# EasyEDA Pro project kuafu01_030内部老化方案_4.eprj, board PCB4 (continued)
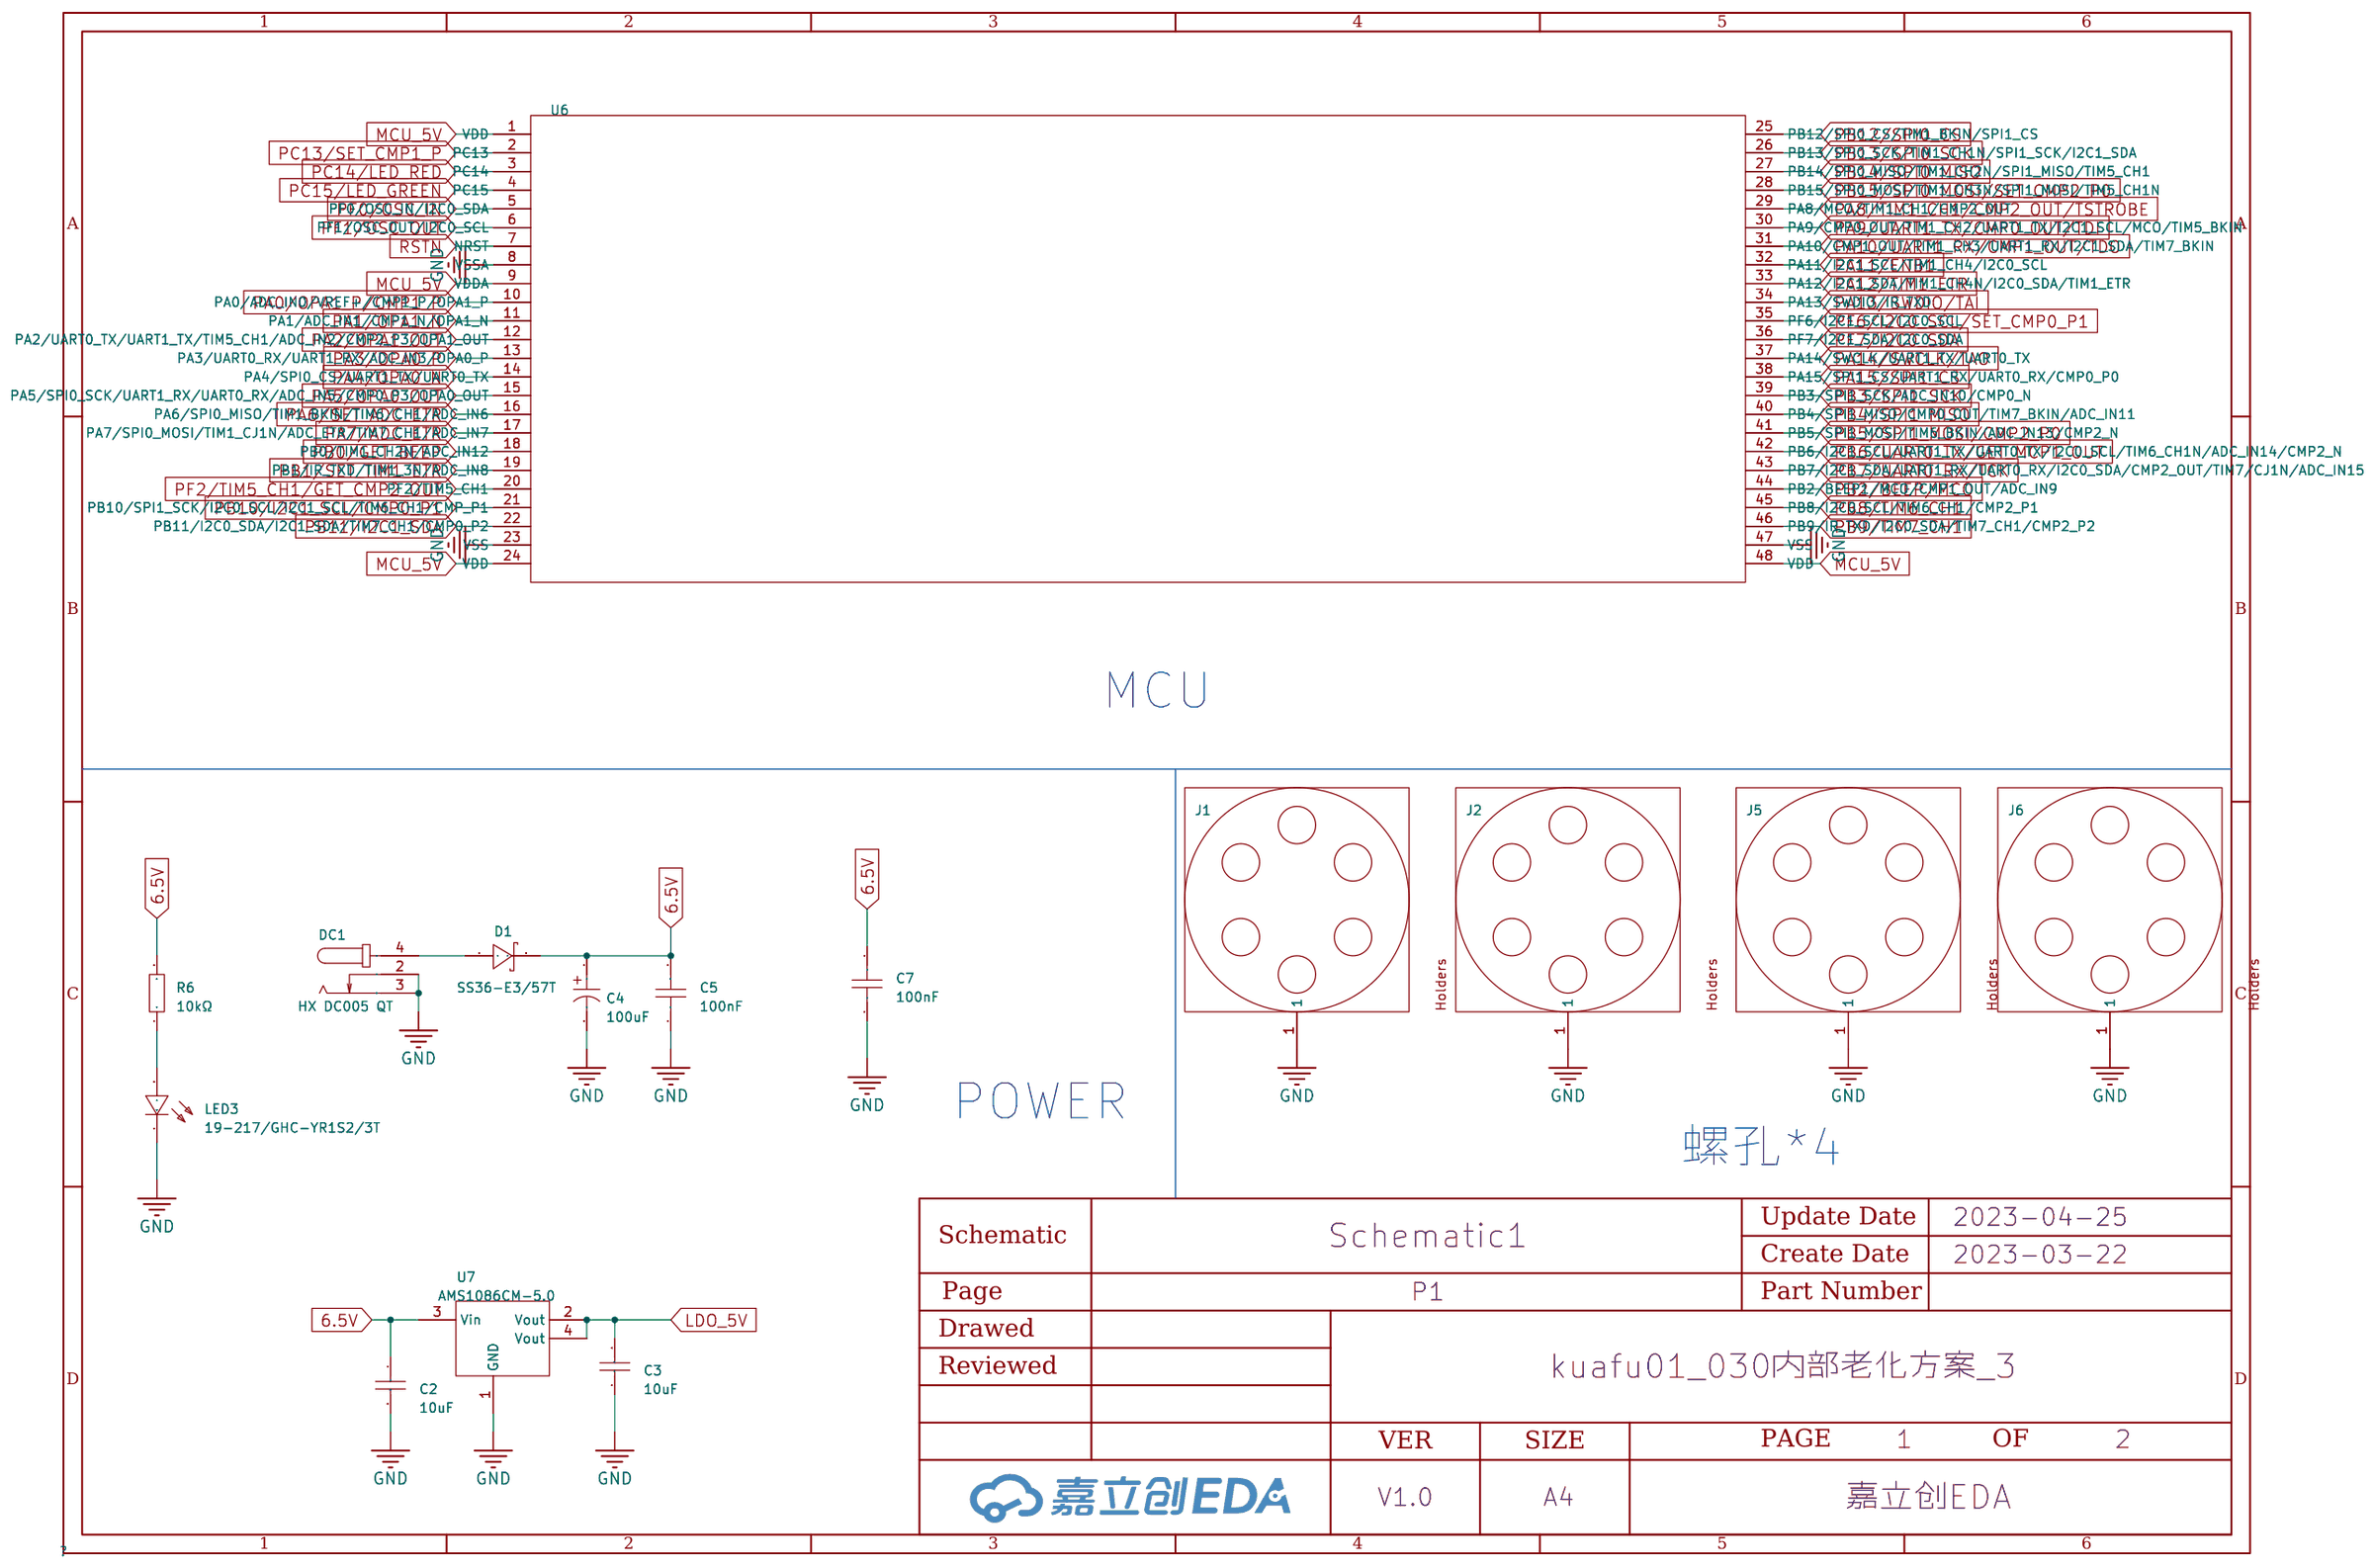
[diagram p0: P1]
## Routing (per net, layer and track width the routed paths; a pad name or vN(x,y) marks a point on that pad's centre or on a via; arc(x,y) is an arc through that point) (continued)
PA13/SWDIO/TAI: length 743
  Top Layer w0.28: U6#5.34 87.84,126.83 88.5,127.49 v1(88.5,127.51) ; U6#8.34 138.38,164.42 139.05,165.09 v1(139.05,165.1) ; v1(88.5,202.69) 88.5,202.68 87.84,202.02 U6#29.34 ; U6#16.34 87.84,51.65 88.5,52.31 v1(88.5,52.32) ; U6#28.34 239.48,202.02 240.14,202.68 v1(240.14,202.69) ; v1(189.59,52.32) 189.59,52.31 188.93,51.65 U6#18.34 ; U6#12.34 138.38,239.61 139.05,240.27 v1(139.05,240.28) ; U6#4.34 239.48,126.83 240.14,127.49 v1(240.14,127.51) ; U6#27.34 37.29,239.61 37.95,240.27 v1(37.95,240.28) ; U6#14.34 37.29,51.65 37.95,52.31 v1(37.95,52.32) ; U6#19.34 138.38,89.24 139.05,89.9 v1(139.05,89.92) ; v1(240.14,89.92) 240.14,89.9 239.48,89.24 U6#17.34 ; v1(189.59,89.92) 189.59,89.9 188.93,89.24 U6#21.34 ; U6#32.34 188.93,202.02 189.59,202.68 v1(189.59,202.69) ; v1(189.59,165.1) 189.59,165.09 188.93,164.42 U6#10.34 ; v1(139.05,127.51) 139.05,127.49 138.38,126.83 U6#2.34 ; v1(88.5,240.28) 88.5,240.27 87.84,239.61 U6.34 ; v1(37.95,165.1) 37.95,165.09 37.29,164.42 U6#9.34 ; v1(240.14,52.32) 240.14,52.31 239.48,51.65 U6#15.34 ; v1(240.14,240.28) 240.14,240.27 239.48,239.61 U6#26.34 ; U6#20.34 37.29,89.24 37.95,89.9 v1(37.95,89.92) ; v1(189.59,127.51) 189.59,127.49 188.93,126.83 U6#7.34 ; U6#13.34 138.38,51.65 139.05,52.31 v1(139.05,52.32) ; U6#31.34 37.29,202.02 37.95,202.68 v1(37.95,202.69) ; U6#11.34 87.84,164.42 88.5,165.09 v1(88.5,165.1) ; U6#25.34 188.93,239.61 189.59,240.27 v1(189.59,240.28) ; v1(37.95,14.73) 37.95,14.72 37.29,14.06 U6#23.34 ; U6#24.34 239.48,14.06 240.14,14.72 v1(240.14,14.73) ; U6#3.34 37.29,126.83 37.95,127.49 v1(37.95,127.51) ; v1(139.05,202.69) 139.05,202.68 138.38,202.02 U6#30.34 ; v1(88.5,89.92) 88.5,89.9 87.84,89.24 U6#22.34 ; v1(240.14,165.1) 240.14,165.09 239.48,164.42 U6#6.34
  Bottom Layer w0.28: CN2#26.4 238,257.24 CN1#26.10 238.14,252.36 240.14,250.37 v1(240.14,240.28) ; CN2#6.4 35.81,182.06 CN1#3.10 35.96,177.18 37.95,175.18 v1(37.95,165.1) ; v1(88.5,240.28) 88.5,250.37 86.5,252.36 CN1#32.10 86.36,257.24 CN2#27.4 ; CN2#9.4 86.36,182.06 CN1#9.10 86.5,177.18 88.5,175.18 v1(88.5,165.1) ; v1(240.14,14.73) 240.14,24.81 238.14,26.81 CN1#23.10 238,31.69 CN2#24.4 ; v1(88.5,52.32) 88.5,62.41 86.5,64.4 CN1#16.10 86.36,69.28 CN2#16.4 ; CN2#5.4 86.36,144.47 CN1#5.10 86.5,139.59 88.5,137.59 v1(88.5,127.51) ; CN2#14.4 136.91,69.28 CN1#19.10 137.05,64.4 139.05,62.41 v1(139.05,52.32) ; v1(240.14,202.69) 240.14,212.77 238.14,214.77 CN1#29.10 238,219.65 CN2#30.4 ; v1(189.59,127.51) 189.59,137.59 187.59,139.59 CN1#10.10 187.45,144.47 CN2#10.4 ; CN2.4 35.81,144.47 CN1#4.10 35.96,139.59 37.95,137.59 v1(37.95,127.51) ; v1(240.14,89.92) 240.14,100 238.14,102 CN1#17.10 238,106.87 CN2#18.4 ; v1(37.95,14.73) 37.95,24.81 35.96,26.81 CN1#22.10 35.81,31.69 CN2#23.4 ; CN2#8.4 136.91,182.06 CN1#7.10 137.05,177.18 139.05,175.18 v1(139.05,165.1) ; CN2#29.4 187.45,219.65 CN1#28.10 187.59,214.77 189.59,212.77 v1(189.59,202.69) ; v1(88.5,202.69) 88.5,212.77 86.5,214.77 CN1#30.10 86.36,219.65 CN2#32.4 ; v1(189.59,52.32) 189.59,62.41 187.59,64.4 CN1#21.10 187.45,69.28 CN2#21.4 ; v1(240.14,165.1) 240.14,175.18 238.14,177.18 CN1#6.10 238,182.06 CN2#7.4 ; CN2#20.4 86.36,106.87 CN1#20.10 86.5,102 88.5,100 v1(88.5,89.92) ; v1(37.95,89.92) 37.95,100 35.96,102 CN1#14.10 35.81,106.87 CN2#17.4 ; CN2#19.4 136.91,106.87 CN1#18.10 137.05,102 139.05,100 v1(139.05,89.92) ; CN2#2.4 238,144.47 CN1.10 238.14,139.59 240.14,137.59 v1(240.14,127.51) ; CN2#15.4 187.45,106.87 CN1#13.10 187.59,102 189.59,100 v1(189.59,89.92) ; v1(189.59,165.1) 189.59,175.18 187.59,177.18 CN1#2.10 187.45,182.06 CN2#4.4 ; v1(37.95,240.28) 37.95,250.37 35.96,252.36 CN1#24.10 35.81,257.24 CN2#25.4 ; v1(139.05,127.51) 139.05,137.59 137.05,139.59 CN1#8.10 136.91,144.47 CN2#3.4 ; CN2#28.4 35.81,219.65 CN1#27.10 35.96,214.77 37.95,212.77 v1(37.95,202.69) ; v1(139.05,202.69) 139.05,212.77 137.05,214.77 CN1#31.10 136.91,219.65 CN2#31.4 ; v1(139.05,240.28) 139.05,250.37 137.05,252.36 CN1#11.10 136.91,257.24 CN2#11.4 ; v1(37.95,52.32) 37.95,62.41 35.96,64.4 CN1#15.10 35.81,69.28 CN2#12.4 ; CN2#22.4 187.45,257.24 CN1#25.10 187.59,252.36 189.59,250.37 v1(189.59,240.28) ; v1(240.14,52.32) 240.14,62.41 238.14,64.4 CN1#12.10 238,69.28 CN2#13.4
PA14/SWCLK/TAO: length 627.5
  Top Layer w0.28: v1(236.71,130.44) 236.24,130.44 235.77,129.97 U6#4.37 ; U6#18.37 185.22,54.78 185.69,55.25 v1(186.16,55.25) ; v1(186.16,243.21) 185.69,243.21 185.22,242.74 U6#25.37 ; v1(34.52,243.21) 34.05,243.21 33.58,242.74 U6#27.37 ; U6#16.37 84.13,54.78 84.6,55.25 v1(85.07,55.25) ; v1(85.07,243.21) 84.6,243.21 84.13,242.74 U6.37 ; U6#13.37 134.67,54.78 135.15,55.25 v1(135.62,55.25) ; U6#2.37 134.67,129.97 135.15,130.44 v1(135.62,130.44) ; U6#15.37 235.77,54.78 236.24,55.25 v1(236.71,55.25) ; v1(34.52,130.44) 34.05,130.44 33.58,129.97 U6#3.37 ; v1(34.52,168.03) 34.05,168.03 33.58,167.56 U6#9.37 ; U6#6.37 235.77,167.56 236.24,168.03 v1(236.71,168.03) ; v1(236.71,92.85) 236.24,92.85 235.77,92.37 U6#17.37 ; U6#11.37 84.13,167.56 84.6,168.03 v1(85.07,168.03) ; v1(34.52,92.85) 34.05,92.85 33.58,92.37 U6#20.37 ; U6#26.37 235.77,242.74 236.24,243.21 v1(236.71,243.21) ; v1(236.71,17.66) 236.24,17.66 235.77,17.19 U6#24.37 ; v1(85.07,92.85) 84.6,92.85 84.13,92.37 U6#22.37 ; v1(135.62,205.62) 135.15,205.62 134.67,205.15 U6#30.37 ; U6#23.37 33.58,17.19 34.05,17.66 v1(34.52,17.66) ; v1(135.62,92.85) 135.15,92.85 134.67,92.37 U6#19.37 ; U6#28.37 235.77,205.15 236.24,205.62 v1(236.71,205.62) ; v1(34.52,55.25) 34.05,55.25 33.58,54.78 U6#14.37 ; U6#31.37 33.58,205.15 34.05,205.62 v1(34.52,205.62) ; U6#29.37 84.13,205.15 84.6,205.62 v1(85.07,205.62) ; U6#32.37 185.22,205.15 185.69,205.62 v1(186.16,205.62) ; v1(186.16,130.44) 185.69,130.44 185.22,129.97 U6#7.37 ; v1(135.62,168.03) 135.15,168.03 134.67,167.56 U6#8.37 ; U6#10.37 185.22,167.56 185.69,168.03 v1(186.16,168.03) ; v1(186.16,92.85) 185.69,92.85 185.22,92.37 U6#21.37 ; v1(85.07,130.44) 84.6,130.44 84.13,129.97 U6#5.37 ; U6#12.37 134.67,242.74 135.15,243.21 v1(135.62,243.21)
  Bottom Layer w0.28: v1(135.62,243.21) 135.62,251.55 134.95,252.22 CN1#11.8 134.37,254.78 CN2#11.2 ; CN2#32.2 83.82,217.19 CN1#30.8 84.4,214.63 85.07,213.96 v1(85.07,205.62) ; CN2#23.2 33.27,29.23 CN1#22.8 33.86,26.67 34.52,26 v1(34.52,17.66) ; v1(135.62,205.62) 135.62,213.96 134.95,214.63 CN1#31.8 134.37,217.19 CN2#31.2 ; v1(85.07,92.85) 85.07,101.19 84.4,101.85 CN1#20.8 83.82,104.41 CN2#20.2 ; v1(85.07,130.44) 85.07,138.78 84.4,139.45 CN1#5.8 83.82,142.01 CN2#5.2 ; CN2#6.2 33.27,179.6 CN1#3.8 33.86,177.04 34.52,176.37 v1(34.52,168.03) ; v1(236.71,17.66) 236.71,26 236.04,26.67 CN1#23.8 235.46,29.23 CN2#24.2 ; v1(186.16,205.62) 186.16,213.96 185.49,214.63 CN1#28.8 184.91,217.19 CN2#29.2 ; v1(186.16,130.44) 186.16,138.78 185.49,139.45 CN1#10.8 184.91,142.01 CN2#10.2 ; CN2.2 33.27,142.01 CN1#4.8 33.86,139.45 34.52,138.78 v1(34.52,130.44) ; v1(85.07,168.03) 85.07,176.37 84.4,177.04 CN1#9.8 83.82,179.6 CN2#9.2 ; CN2#3.2 134.37,142.01 CN1#8.8 134.95,139.45 135.62,138.78 v1(135.62,130.44) ; v1(236.71,168.03) 236.71,176.37 236.04,177.04 CN1#6.8 235.46,179.6 CN2#7.2 ; CN2#14.2 134.37,66.82 CN1#19.8 134.95,64.26 135.62,63.59 v1(135.62,55.25) ; CN2#30.2 235.46,217.19 CN1#29.8 236.04,214.63 236.71,213.96 v1(236.71,205.62) ; v1(186.16,55.25) 186.16,63.59 185.49,64.26 CN1#21.8 184.91,66.82 CN2#21.2 ; CN2#8.2 134.37,179.6 CN1#7.8 134.95,177.04 135.62,176.37 v1(135.62,168.03) ; CN2#17.2 33.27,104.41 CN1#14.8 33.86,101.85 34.52,101.19 v1(34.52,92.85) ; v1(236.71,92.85) 236.71,101.19 236.04,101.85 CN1#17.8 235.46,104.41 CN2#18.2 ; CN2#2.2 235.46,142.01 CN1.8 236.04,139.45 236.71,138.78 v1(236.71,130.44) ; CN2#4.2 184.91,179.6 CN1#2.8 185.49,177.04 186.16,176.37 v1(186.16,168.03) ; CN2#12.2 33.27,66.82 CN1#15.8 33.86,64.26 34.52,63.59 v1(34.52,55.25) ; CN2#27.2 83.82,254.78 CN1#32.8 84.4,252.22 85.07,251.55 v1(85.07,243.21) ; v1(236.71,55.25) 236.71,63.59 236.04,64.26 CN1#12.8 235.46,66.82 CN2#13.2 ; CN2#28.2 33.27,217.19 CN1#27.8 33.86,214.63 34.52,213.96 v1(34.52,205.62) ; v1(236.71,243.21) 236.71,251.55 236.04,252.22 CN1#26.8 235.46,254.78 CN2#26.2 ; v1(85.07,55.25) 85.07,63.59 84.4,64.26 CN1#16.8 83.82,66.82 CN2#16.2 ; CN2#22.2 184.91,254.78 CN1#25.8 185.49,252.22 186.16,251.55 v1(186.16,243.21) ; CN2#15.2 184.91,104.41 CN1#13.8 185.49,101.85 186.16,101.19 v1(186.16,92.85) ; CN2#19.2 134.37,104.41 CN1#18.8 134.95,101.85 135.62,101.19 v1(135.62,92.85) ; v1(34.52,243.21) 34.52,251.55 33.86,252.22 CN1#24.8 33.27,254.78 CN2#25.2
PA15/SPI1_CS: length 652.9
  Top Layer w0.28: 235.27,166.88 235.27,167.86 236.16,168.75 v1(241.05,168.75) ; v1(139.96,131.16) 135.07,131.16 134.18,130.27 134.18,129.28 ; v1(38.86,55.97) 33.97,55.97 33.08,55.08 33.08,54.1 ; U6#31.25 35.7,197.52 36.12,197.09 v1(38.87,197.09) ; v1(190.5,131.16) 185.61,131.16 184.72,130.27 184.72,129.28 ; 184.72,54.1 184.72,55.08 185.61,55.97 v1(190.5,55.97) ; v1(38.86,168.75) 33.97,168.75 33.08,167.86 33.08,166.88 ; U6#25.25 187.34,235.11 187.76,234.68 v1(190.51,234.68) ; v1(139.97,46.72) 137.22,46.72 136.79,47.15 U6#13.25 ; v1(241.05,93.57) 236.16,93.57 235.27,92.68 235.27,91.69 ; v1(241.06,159.5) 238.31,159.5 237.88,159.92 U6#6.25 ; v1(38.87,159.5) 36.12,159.5 35.7,159.92 U6#9.25 ; 235.27,129.28 235.27,130.27 236.16,131.16 v1(241.05,131.16) ; v1(139.96,93.57) 135.07,93.57 134.18,92.68 134.18,91.69 ; v1(89.41,93.57) 84.52,93.57 83.63,92.68 83.63,91.69 ; v1(241.05,18.38) 236.16,18.38 235.27,17.49 235.27,16.51 ; U6#3.25 35.7,122.33 36.12,121.91 v1(38.87,121.91) ; v1(38.87,46.72) 36.12,46.72 35.7,47.15 U6#14.25 ; v1(190.5,168.75) 185.61,168.75 184.72,167.86 184.72,166.88 ; 134.18,242.06 134.18,243.04 135.07,243.93 v1(139.96,243.93) ; U6#5.25 86.25,122.33 86.67,121.91 v1(89.42,121.91) ; v1(89.41,131.16) 84.52,131.16 83.63,130.27 83.63,129.28 ; v1(38.86,206.34) 33.97,206.34 33.08,205.45 33.08,204.47 ; U6.25 86.25,235.11 86.67,234.68 v1(89.42,234.68) ; 83.63,166.88 83.63,167.86 84.52,168.75 v1(89.41,168.75) ; 83.63,54.1 83.63,55.08 84.52,55.97 v1(89.41,55.97) ; v1(139.96,55.97) 135.07,55.97 134.18,55.08 134.18,54.1 ; U6#24.25 237.88,9.56 238.31,9.13 v1(241.06,9.13) ; U6#30.25 136.79,197.52 137.22,197.09 v1(139.97,197.09) ; U6#4.25 237.88,122.33 238.31,121.91 v1(241.06,121.91) ; v1(89.41,206.34) 84.52,206.34 83.63,205.45 83.63,204.47 ; U6#18.25 187.34,47.15 187.76,46.72 v1(190.51,46.72) ; v1(190.51,197.09) 187.76,197.09 187.34,197.52 U6#32.25 ; 83.63,242.06 83.63,243.04 84.52,243.93 v1(89.41,243.93) ; v1(190.51,159.5) 187.76,159.5 187.34,159.92 U6#10.25 ; v1(190.5,93.57) 185.61,93.57 184.72,92.68 184.72,91.69 ; U6#26.25 237.88,235.11 238.31,234.68 v1(241.06,234.68) ; v1(190.51,84.32) 187.76,84.32 187.34,84.74 U6#21.25 ; U6#12.25 136.79,235.11 137.22,234.68 v1(139.97,234.68) ; U6#23.25 35.7,9.56 36.12,9.13 v1(38.87,9.13) ; v1(89.42,197.09) 86.67,197.09 86.25,197.52 U6#29.25 ; v1(38.86,93.57) 33.97,93.57 33.08,92.68 33.08,91.69 ; v1(241.05,243.93) 236.16,243.93 235.27,243.04 235.27,242.06 ; v1(241.06,197.09) 238.31,197.09 237.88,197.52 U6#28.25 ; U6#8.25 136.79,159.92 137.22,159.5 v1(139.97,159.5) ; U6#15.25 237.88,47.15 238.31,46.72 v1(241.06,46.72) ; v1(190.5,243.93) 185.61,243.93 184.72,243.04 184.72,242.06 ; v1(241.05,55.97) 236.16,55.97 235.27,55.08 235.27,54.1 ; v1(241.05,206.34) 236.16,206.34 235.27,205.45 235.27,204.47 ; v1(38.86,243.93) 33.97,243.93 33.08,243.04 33.08,242.06 ; U6#19.25 136.79,84.74 137.22,84.32 v1(139.97,84.32) ; 134.18,166.88 134.18,167.86 135.07,168.75 v1(139.96,168.75) ; v1(139.96,206.34) 135.07,206.34 134.18,205.45 134.18,204.47 ; U6#22.25 86.25,84.74 86.67,84.32 v1(89.42,84.32) ; v1(89.42,46.72) 86.67,46.72 86.25,47.15 U6#16.25 ; U6#2.25 136.79,122.33 137.22,121.91 v1(139.97,121.91) ; v1(241.06,84.32) 238.31,84.32 237.88,84.74 U6#17.25 ; v1(38.86,131.16) 33.97,131.16 33.08,130.27 33.08,129.28 ; v1(38.86,18.38) 33.97,18.38 33.08,17.49 33.08,16.51 ; U6#7.25 187.34,122.33 187.76,121.91 v1(190.51,121.91) ; U6#11.25 86.25,159.92 86.67,159.5 v1(89.42,159.5) ; 184.72,204.47 184.72,205.45 185.61,206.34 v1(190.5,206.34) ; v1(38.87,234.68) 36.12,234.68 35.7,235.11 U6#27.25 ; v1(38.87,84.32) 36.12,84.32 35.7,84.74 U6#20.25
  Bottom Layer w0.28: v1(89.41,243.93) 89.41,234.69 v1(89.42,234.68) ; v1(190.51,46.72) 190.5,46.73 v1(190.5,55.97) ; v1(38.87,159.5) 38.86,159.51 v1(38.86,168.75) ; v1(38.87,84.32) 38.86,84.33 v1(38.86,93.57) ; v1(190.51,159.5) 190.5,159.51 v1(190.5,168.75) ; v1(241.06,197.09) 241.05,197.1 v1(241.05,206.34) ; v1(190.5,206.34) 190.5,197.1 v1(190.51,197.09) ; v1(38.86,206.34) 38.86,197.1 v1(38.87,197.09) ; v1(241.06,121.91) 241.05,121.92 v1(241.05,131.16) ; v1(139.97,46.72) 139.96,46.73 v1(139.96,55.97) ; v1(241.06,9.13) 241.05,9.14 v1(241.05,18.38) ; v1(139.97,197.09) 139.96,197.1 v1(139.96,206.34) ; v1(89.42,46.72) 89.41,46.73 v1(89.41,55.97) ; v1(241.06,234.68) 241.05,234.69 v1(241.05,243.93) ; v1(241.06,46.72) 241.05,46.73 v1(241.05,55.97) ; v1(190.5,243.93) 190.5,234.69 v1(190.51,234.68) ; v1(89.41,93.57) 89.41,84.33 v1(89.42,84.32) ; v1(241.06,159.5) 241.05,159.51 v1(241.05,168.75) ; v1(89.42,197.09) 89.41,197.1 v1(89.41,206.34) ; v1(139.97,84.32) 139.96,84.33 v1(139.96,93.57) ; v1(241.06,84.32) 241.05,84.33 v1(241.05,93.57) ; v1(89.41,168.75) 89.41,159.51 v1(89.42,159.5) ; v1(89.42,121.91) 89.41,121.92 v1(89.41,131.16) ; v1(139.97,159.5) 139.96,159.51 v1(139.96,168.75) ; v1(38.86,131.16) 38.86,121.92 v1(38.87,121.91) ; v1(38.86,55.97) 38.86,46.73 v1(38.87,46.72) ; v1(190.51,121.91) 190.5,121.92 v1(190.5,131.16) ; v1(139.96,131.16) 139.96,121.92 v1(139.97,121.91) ; v1(190.51,84.32) 190.5,84.33 v1(190.5,93.57) ; v1(38.86,18.38) 38.86,9.14 v1(38.87,9.13) ; v1(139.97,234.68) 139.96,234.69 v1(139.96,243.93) ; v1(38.87,234.68) 38.86,234.69 v1(38.86,243.93)
PB0/GET_BEEP: length 2704.9
  Top Layer w0.28: U6#19.44 131.17,96.36 ; 131.17,96.36 131.13,96.36 ; 131.17,96.36 131.62,96.81 142.23,96.81 143.46,98.03 154.48,98.03 155.77,96.75 155.77,79.88 154.42,78.53 145.27,78.53 ; 30.08,171.55 30.04,171.55 ; 30.08,171.55 U6#9.44 ; 30.08,171.55 30.52,171.99 41.14,171.99 42.37,173.22 53.39,173.22 54.67,171.93 54.67,155.06 53.32,153.71 44.18,153.71 ; H13.1 94.74,228.91 94.73,228.89 ; 44.18,78.53 44.2,78.54 H13#13.1 ; 44.18,78.53 53.32,78.53 54.67,79.88 54.67,96.75 53.39,98.03 42.37,98.03 41.14,96.81 30.52,96.81 30.08,96.36 ; 44.18,78.53 31.44,78.53 30.58,79.39 U6#20.18 ; 80.63,96.36 80.59,96.36 ; 80.63,96.36 U6#22.44 ; 80.63,96.36 81.07,96.81 91.69,96.81 92.91,98.03 103.93,98.03 105.22,96.75 105.22,79.88 103.87,78.53 94.73,78.53 ; 94.73,228.89 81.99,228.89 81.13,229.76 81.13,233.66 ; 94.73,228.89 103.87,228.89 105.22,230.24 105.22,247.11 103.93,248.4 92.91,248.4 91.69,247.17 81.07,247.17 80.63,246.73 ; 80.63,209.14 81.07,209.58 91.69,209.58 92.91,210.81 103.93,210.81 105.22,209.52 105.22,192.65 103.87,191.3 94.73,191.3 ; 80.63,209.14 80.59,209.14 ; 80.63,209.14 U6#29.44 ; 145.27,191.3 132.54,191.3 131.68,192.16 U6#30.18 ; 145.27,191.3 154.42,191.3 155.77,192.65 155.77,209.52 154.48,210.81 143.46,210.81 142.23,209.58 131.62,209.58 131.17,209.14 ; 145.27,191.3 145.29,191.32 H13#32.1 ; 195.82,191.3 204.96,191.3 206.31,192.65 206.31,209.52 205.02,210.81 194.01,210.81 192.78,209.58 182.16,209.58 181.72,209.14 ; 195.82,191.3 183.08,191.3 182.22,192.16 182.22,196.07 ; 195.82,191.3 195.83,191.32 H13#30.1 ; 145.27,228.89 145.29,228.91 H13#11.1 ; 145.27,228.89 154.42,228.89 155.77,230.24 155.77,247.11 154.48,248.4 143.46,248.4 142.23,247.17 131.62,247.17 131.17,246.73 ; 145.27,228.89 132.54,228.89 131.68,229.76 U6#12.18 ; H13#27.1 246.38,228.91 246.37,228.89 ; 94.73,40.93 94.74,40.95 H13#15.1 ; 94.73,40.93 81.99,40.93 81.13,41.8 81.13,45.7 ; 94.73,40.93 103.87,40.93 105.22,42.28 105.22,59.15 103.93,60.44 92.91,60.44 91.69,59.21 81.07,59.21 80.63,58.77 ; 80.63,246.73 80.59,246.73 ; 80.63,246.73 U6.44 ; H13#24.1 246.38,3.36 246.37,3.34 ; 44.18,3.34 44.2,3.36 H13#23.1 ; 44.18,3.34 31.44,3.34 30.58,4.2 U6#23.18 ; 44.18,3.34 53.32,3.34 54.67,4.69 54.67,21.56 53.39,22.85 42.37,22.85 41.14,21.62 30.52,21.62 30.08,21.18 ; U6#16.44 80.63,58.77 ; 80.63,58.77 80.59,58.77 ; 195.82,228.89 183.08,228.89 182.22,229.76 182.22,233.66 ; 195.82,228.89 204.96,228.89 206.31,230.24 206.31,247.11 205.02,248.4 194.01,248.4 192.78,247.17 182.16,247.17 181.72,246.73 ; 195.82,228.89 195.83,228.91 H13#25.1 ; 195.82,78.53 204.96,78.53 206.31,79.88 206.31,96.75 205.02,98.03 194.01,98.03 192.78,96.81 182.16,96.81 181.72,96.36 ; 195.82,78.53 195.83,78.54 H13#22.1 ; 195.82,78.53 183.08,78.53 182.22,79.39 182.22,83.29 ; 195.82,40.93 204.96,40.93 206.31,42.28 206.31,59.15 205.02,60.44 194.01,60.44 192.78,59.21 182.16,59.21 181.72,58.77 ; 195.82,40.93 195.83,40.95 H13#17.1 ; 195.82,40.93 183.08,40.93 182.22,41.8 182.22,45.7 ; 30.08,21.18 30.04,21.18 ; 30.08,21.18 U6#23.44 ; 94.73,191.3 81.99,191.3 81.13,192.16 81.13,196.07 ; 94.73,191.3 94.74,191.32 H13#31.1 ; 246.37,191.3 255.51,191.3 256.86,192.65 256.86,209.52 255.57,210.81 244.55,210.81 243.33,209.58 232.71,209.58 232.27,209.14 ; 246.37,191.3 233.63,191.3 232.77,192.16 U6#28.18 ; 246.37,191.3 246.38,191.32 H13#29.1 ; 195.82,116.12 204.96,116.12 206.31,117.47 206.31,134.34 205.02,135.62 194.01,135.62 192.78,134.4 182.16,134.4 181.72,133.96 ; 195.82,116.12 195.83,116.13 H13#6.1 ; 195.82,116.12 183.08,116.12 182.22,116.98 182.22,120.88 ; 44.18,153.71 31.44,153.71 30.58,154.57 U6#9.18 ; 44.18,153.71 44.2,153.72 H13#2.1 ; U6#18.44 181.72,58.77 ; 181.72,58.77 181.68,58.77 ; 94.73,116.12 81.99,116.12 81.13,116.98 81.13,120.88 ; 94.73,116.12 103.87,116.12 105.22,117.47 105.22,134.34 103.93,135.62 92.91,135.62 91.69,134.4 81.07,134.4 80.63,133.96 ; 94.73,116.12 94.74,116.13 H13#4.1 ; 145.27,116.12 132.54,116.12 131.68,116.98 U6#2.18 ; 145.27,116.12 154.42,116.12 155.77,117.47 155.77,134.34 154.48,135.62 143.46,135.62 142.23,134.4 131.62,134.4 131.17,133.96 ; 145.27,116.12 145.29,116.13 H13#5.1 ; 131.17,58.77 131.62,59.21 142.23,59.21 143.46,60.44 154.48,60.44 155.77,59.15 155.77,42.28 154.42,40.93 145.27,40.93 ; 131.17,58.77 131.13,58.77 ; 131.17,58.77 U6#13.44 ; 232.27,171.55 232.23,171.55 ; 232.27,171.55 232.71,171.99 243.33,171.99 244.55,173.22 255.57,173.22 256.86,171.93 256.86,155.06 255.51,153.71 246.37,153.71 ; 232.27,171.55 U6#6.44 ; 30.08,246.73 30.04,246.73 ; 30.08,246.73 30.52,247.17 41.14,247.17 42.37,248.4 53.39,248.4 54.67,247.11 54.67,230.24 53.32,228.89 44.18,228.89 ; 30.08,246.73 U6#27.44 ; U6#25.44 181.72,246.73 ; 181.72,246.73 181.68,246.73 ; U6#7.44 181.72,133.96 ; 181.72,133.96 181.68,133.96 ; 232.27,58.77 232.71,59.21 243.33,59.21 244.55,60.44 255.57,60.44 256.86,59.15 256.86,42.28 255.51,40.93 246.37,40.93 ; 232.27,58.77 232.23,58.77 ; 232.27,58.77 U6#15.44 ; 246.37,228.89 233.63,228.89 232.77,229.76 U6#26.18 ; 246.37,228.89 255.51,228.89 256.86,230.24 256.86,247.11 255.57,248.4 244.55,248.4 243.33,247.17 232.71,247.17 232.27,246.73 ; 30.08,96.36 30.04,96.36 ; 30.08,96.36 U6#20.44 ; U6#31.44 30.08,209.14 ; 30.08,209.14 30.04,209.14 ; 30.08,209.14 30.52,209.58 41.14,209.58 42.37,210.81 53.39,210.81 54.67,209.52 54.67,192.65 53.32,191.3 44.18,191.3 ; 232.27,96.36 232.23,96.36 ; 232.27,96.36 U6#17.44 ; 232.27,96.36 232.71,96.81 243.33,96.81 244.55,98.03 255.57,98.03 256.86,96.75 256.86,79.88 255.51,78.53 246.37,78.53 ; 94.73,78.53 81.99,78.53 81.13,79.39 81.13,83.29 ; 94.73,78.53 94.74,78.54 H13#19.1 ; 232.27,209.14 232.23,209.14 ; 232.27,209.14 U6#28.44 ; 246.37,40.93 233.63,40.93 232.77,41.8 U6#15.18 ; 246.37,40.93 246.38,40.95 H13#20.1 ; U6#3.18 30.58,116.98 31.44,116.12 44.18,116.12 ; 145.27,40.93 145.29,40.95 H13#16.1 ; 145.27,40.93 132.54,40.93 131.68,41.8 U6#13.18 ; 232.27,133.96 232.71,134.4 243.33,134.4 244.55,135.62 255.57,135.62 256.86,134.34 256.86,117.47 255.51,116.12 246.37,116.12 ; 232.27,133.96 232.23,133.96 ; 232.27,133.96 U6#4.44 ; 131.17,133.96 U6#2.44 ; 131.17,133.96 131.13,133.96 ; 131.17,246.73 131.13,246.73 ; 131.17,246.73 U6#12.44 ; U6#27.18 30.58,229.76 31.44,228.89 44.18,228.89 ; 131.17,209.14 131.13,209.14 ; 131.17,209.14 U6#30.44 ; 246.37,78.53 246.38,78.54 H13#18.1 ; 246.37,78.53 233.63,78.53 232.77,79.39 U6#17.18 ; H13#26.1 44.2,228.91 44.18,228.89 ; 246.37,116.12 233.63,116.12 232.77,116.98 U6#4.18 ; 246.37,116.12 246.38,116.13 H13#9.1 ; U6#8.18 131.68,154.57 132.54,153.71 145.27,153.71 ; 94.73,153.71 81.99,153.71 81.13,154.57 81.13,158.47 ; 94.73,153.71 94.74,153.72 H13#8.1 ; 94.73,153.71 103.87,153.71 105.22,155.06 105.22,171.93 103.93,173.22 92.91,173.22 91.69,171.99 81.07,171.99 80.63,171.55 ; 232.27,21.18 232.71,21.62 243.33,21.62 244.55,22.85 255.57,22.85 256.86,21.56 256.86,4.69 255.51,3.34 246.37,3.34 ; 232.27,21.18 232.23,21.18 ; 232.27,21.18 U6#24.44 ; H13#28.1 44.2,191.32 44.18,191.3 ; 181.72,171.55 182.16,171.99 192.78,171.99 194.01,173.22 205.02,173.22 206.31,171.93 206.31,155.06 204.96,153.71 195.82,153.71 ; 181.72,171.55 181.68,171.55 ; 181.72,171.55 U6#10.44 ; 30.08,58.77 30.04,58.77 ; 30.08,58.77 U6#14.44 ; 30.08,58.77 30.52,59.21 41.14,59.21 42.37,60.44 53.39,60.44 54.67,59.15 54.67,42.28 53.32,40.93 44.18,40.93 ; 246.37,3.34 233.63,3.34 232.77,4.2 U6#24.18 ; 131.17,171.55 131.62,171.99 142.23,171.99 143.46,173.22 154.48,173.22 155.77,171.93 155.77,155.06 154.42,153.71 145.27,153.71 ; 131.17,171.55 U6#8.44 ; 131.17,171.55 131.13,171.55 ; H13#14.1 44.2,40.95 44.18,40.93 ; U6#21.44 181.72,96.36 ; 181.72,96.36 181.68,96.36 ; 44.18,191.3 31.44,191.3 30.58,192.16 U6#31.18 ; U6#26.44 232.27,246.73 ; 232.27,246.73 232.23,246.73 ; 44.18,116.12 44.2,116.13 H13#3.1 ; 44.18,116.12 53.32,116.12 54.67,117.47 54.67,134.34 53.39,135.62 42.37,135.62 41.14,134.4 30.52,134.4 30.08,133.96 ; 145.27,153.71 145.29,153.72 H13#10.1 ; H13#21.1 145.29,78.54 145.27,78.53 ; H13#7.1 246.38,153.72 246.37,153.71 ; 44.18,40.93 31.44,40.93 30.58,41.8 U6#14.18 ; 246.37,153.71 233.63,153.71 232.77,154.57 U6#6.18 ; 181.72,209.14 181.68,209.14 ; 181.72,209.14 U6#32.44 ; 80.63,171.55 80.59,171.55 ; 80.63,171.55 U6#11.44 ; 195.82,153.71 183.08,153.71 182.22,154.57 182.22,158.47 ; 195.82,153.71 195.83,153.72 H13#12.1 ; 145.27,78.53 132.54,78.53 131.68,79.39 U6#19.18 ; 30.08,133.96 30.04,133.96 ; 30.08,133.96 U6#3.44 ; U6#5.44 80.63,133.96 ; 80.63,133.96 80.59,133.96
  Bottom Layer w0.28: CN1#8.6 130.6,138.22 130.6,134.5 v1(131.14,133.96) ; CN1#27.6 29.5,213.4 29.5,209.68 v1(30.04,209.14) ; v1(232.23,171.55) 231.69,172.09 231.69,175.81 CN1#6.6 ; CN1#19.6 130.6,63.03 130.6,59.31 v1(131.14,58.77) ; CN1#5.6 80.05,138.22 80.05,134.5 v1(80.59,133.96) ; CN1#18.6 130.6,100.62 130.6,96.91 v1(131.14,96.37) ; CN1#15.6 29.5,63.03 29.5,59.31 v1(30.04,58.77) ; CN1#13.6 181.14,100.62 181.14,96.91 v1(181.68,96.37) ; v1(131.14,246.73) 130.6,247.27 130.6,250.99 CN1#11.6 ; v1(80.59,209.14) 80.05,209.68 80.05,213.4 CN1#30.6 ; CN1#26.6 231.69,250.99 231.69,247.27 v1(232.23,246.73) ; CN1#4.6 29.5,138.22 29.5,134.5 v1(30.04,133.96) ; CN1#17.6 231.69,100.62 231.69,96.91 v1(232.23,96.37) ; CN1.6 231.69,138.22 231.69,134.5 v1(232.23,133.96) ; CN1#22.6 29.5,25.44 29.5,21.72 v1(30.04,21.18) ; v1(232.23,209.14) 231.69,209.68 231.69,213.4 CN1#29.6 ; v1(181.68,209.14) 181.14,209.68 181.14,213.4 CN1#28.6 ; CN1#2.6 181.14,175.81 181.14,172.09 v1(181.68,171.55) ; v1(80.59,171.55) 80.05,172.09 80.05,175.81 CN1#9.6 ; v1(181.68,246.73) 181.14,247.27 181.14,250.99 CN1#25.6 ; CN1#20.6 80.05,100.62 80.05,96.91 v1(80.59,96.37) ; v1(131.14,171.55) 130.6,172.09 130.6,175.81 CN1#7.6 ; CN1#23.6 231.69,25.44 231.69,21.72 v1(232.23,21.18) ; CN1#24.6 29.5,250.99 29.5,247.27 v1(30.04,246.73) ; v1(232.23,58.77) 231.69,59.31 231.69,63.03 CN1#12.6 ; CN1#21.6 181.14,63.03 181.14,59.31 v1(181.68,58.77) ; v1(181.68,133.96) 181.14,134.5 181.14,138.22 CN1#10.6 ; v1(80.59,246.73) 80.05,247.27 80.05,250.99 CN1#32.6 ; CN1#16.6 80.05,63.03 80.05,59.31 v1(80.59,58.77) ; CN1#31.6 130.6,213.4 130.6,209.68 v1(131.14,209.14) ; CN1#3.6 29.5,175.81 29.5,172.09 v1(30.04,171.55) ; CN1#14.6 29.5,100.62 29.5,96.91 v1(30.04,96.37)
PB6/UART0_TX/GET_MCP1_OUT: length 1315.6
  Top Layer w0.28: H3#20.2 147.85,88.12 153.87,88.12 154.67,88.92 154.67,96.28 153.77,97.17 143.82,97.17 142.53,95.89 133.91,95.89 132.17,94.15 U6#19.42 ; H3#30.2 97.3,200.89 103.32,200.89 104.12,201.69 104.12,209.05 103.23,209.94 93.27,209.94 91.99,208.66 83.36,208.66 81.63,206.93 U6#29.42 ; H3#26.2 198.4,238.48 204.41,238.48 205.21,239.28 205.21,246.64 204.32,247.54 194.36,247.54 193.08,246.25 184.45,246.25 182.72,244.52 U6#25.42 ; U6#15.42 233.27,56.56 235,58.29 243.63,58.29 244.91,59.58 254.87,59.58 255.76,58.68 255.76,51.32 254.96,50.52 248.94,50.52 H3#18.2 ; U6#17.42 233.27,94.15 235,95.89 243.63,95.89 244.91,97.17 254.87,97.17 255.76,96.28 255.76,88.92 254.96,88.12 248.94,88.12 H3#15.2 ; U6#24.42 233.27,18.97 235,20.7 243.63,20.7 244.91,21.98 254.87,21.98 255.76,21.09 255.76,13.73 254.96,12.93 248.94,12.93 H3#24.2 ; H3#13.2 97.3,50.52 103.32,50.52 104.12,51.32 104.12,58.68 103.23,59.58 93.27,59.58 91.99,58.29 83.36,58.29 81.63,56.56 U6#16.42 ; H3#19.2 198.4,50.52 204.41,50.52 205.21,51.32 205.21,58.68 204.32,59.58 194.36,59.58 193.08,58.29 184.45,58.29 182.72,56.56 U6#18.42 ; U6#10.42 182.72,169.34 184.45,171.07 193.08,171.07 194.36,172.35 204.32,172.35 205.21,171.46 205.21,164.1 204.41,163.3 198.4,163.3 H3#11.2 ; U6#7.42 182.72,131.75 184.45,133.48 193.08,133.48 194.36,134.76 204.32,134.76 205.21,133.87 205.21,126.51 204.41,125.71 198.4,125.71 H3#8.2 ; U6#23.42 31.08,18.97 32.81,20.7 41.44,20.7 42.73,21.98 52.68,21.98 53.57,21.09 53.57,13.73 52.77,12.93 46.76,12.93 H3#23.2 ; U6#31.42 31.08,206.93 32.81,208.66 41.44,208.66 42.73,209.94 52.68,209.94 53.57,209.05 53.57,201.69 52.77,200.89 46.76,200.89 H3#29.2 ; H3#3.2 46.76,125.71 52.77,125.71 53.57,126.51 53.57,133.87 52.68,134.76 42.73,134.76 41.44,133.48 32.81,133.48 31.08,131.75 U6#3.42 ; U6#2.42 132.17,131.75 133.91,133.48 142.53,133.48 143.82,134.76 153.77,134.76 154.67,133.87 154.67,126.51 153.87,125.71 147.85,125.71 H3#5.2 ; H3#2.2 97.3,125.71 103.32,125.71 104.12,126.51 104.12,133.87 103.23,134.76 93.27,134.76 91.99,133.48 83.36,133.48 81.63,131.75 U6#5.42 ; U6#20.42 31.08,94.15 32.81,95.89 41.44,95.89 42.73,97.17 52.68,97.17 53.57,96.28 53.57,88.92 52.77,88.12 46.76,88.12 H3#17.2 ; H3#21.2 97.3,88.12 103.32,88.12 104.12,88.92 104.12,96.28 103.23,97.17 93.27,97.17 91.99,95.89 83.36,95.89 81.63,94.15 U6#22.42 ; U6#9.42 31.08,169.34 32.81,171.07 41.44,171.07 42.73,172.35 52.68,172.35 53.57,171.46 53.57,164.1 52.77,163.3 46.76,163.3 H3#6.2 ; U6#8.42 132.17,169.34 133.91,171.07 142.53,171.07 143.82,172.35 153.77,172.35 154.67,171.46 154.67,164.1 153.87,163.3 147.85,163.3 H3#9.2 ; H3.2 97.3,238.48 103.32,238.48 104.12,239.28 104.12,246.64 103.23,247.54 93.27,247.54 91.99,246.25 83.36,246.25 81.63,244.52 U6.42 ; U6#26.42 233.27,244.52 235,246.25 243.63,246.25 244.91,247.54 254.87,247.54 255.76,246.64 255.76,239.28 254.96,238.48 248.94,238.48 H3#27.2 ; H3#4.2 248.94,163.3 254.96,163.3 255.76,164.1 255.76,171.46 254.87,172.35 244.91,172.35 243.63,171.07 235,171.07 233.27,169.34 U6#6.42 ; U6#32.42 182.72,206.93 184.45,208.66 193.08,208.66 194.36,209.94 204.32,209.94 205.21,209.05 205.21,201.69 204.41,200.89 198.4,200.89 H3#32.2 ; U6#12.42 132.17,244.52 133.91,246.25 142.53,246.25 143.82,247.54 153.77,247.54 154.67,246.64 154.67,239.28 153.87,238.48 147.85,238.48 H3#12.2 ; U6#21.42 182.72,94.15 184.45,95.89 193.08,95.89 194.36,97.17 204.32,97.17 205.21,96.28 205.21,88.92 204.41,88.12 198.4,88.12 H3#22.2 ; U6#27.42 31.08,244.52 32.81,246.25 41.44,246.25 42.73,247.54 52.68,247.54 53.57,246.64 53.57,239.28 52.77,238.48 46.76,238.48 H3#25.2 ; U6#4.42 233.27,131.75 235,133.48 243.63,133.48 244.91,134.76 254.87,134.76 255.76,133.87 255.76,126.51 254.96,125.71 248.94,125.71 H3#7.2 ; U6#11.42 81.63,169.34 83.36,171.07 91.99,171.07 93.27,172.35 103.23,172.35 104.12,171.46 104.12,164.1 103.32,163.3 97.3,163.3 H3#10.2 ; U6#13.42 132.17,56.56 133.91,58.29 142.53,58.29 143.82,59.58 153.77,59.58 154.67,58.68 154.67,51.32 153.87,50.52 147.85,50.52 H3#16.2 ; U6#30.42 132.17,206.93 133.91,208.66 142.53,208.66 143.82,209.94 153.77,209.94 154.67,209.05 154.67,201.69 153.87,200.89 147.85,200.89 H3#31.2 ; H3#28.2 248.94,200.89 254.96,200.89 255.76,201.69 255.76,209.05 254.87,209.94 244.91,209.94 243.63,208.66 235,208.66 233.27,206.93 U6#28.42 ; U6#14.42 31.08,56.56 32.81,58.29 41.44,58.29 42.73,59.58 52.68,59.58 53.57,58.68 53.57,51.32 52.77,50.52 46.76,50.52 H3#14.2